# Altium schematic sheet schematic1.SchDoc (part 1 of 3) (continued)
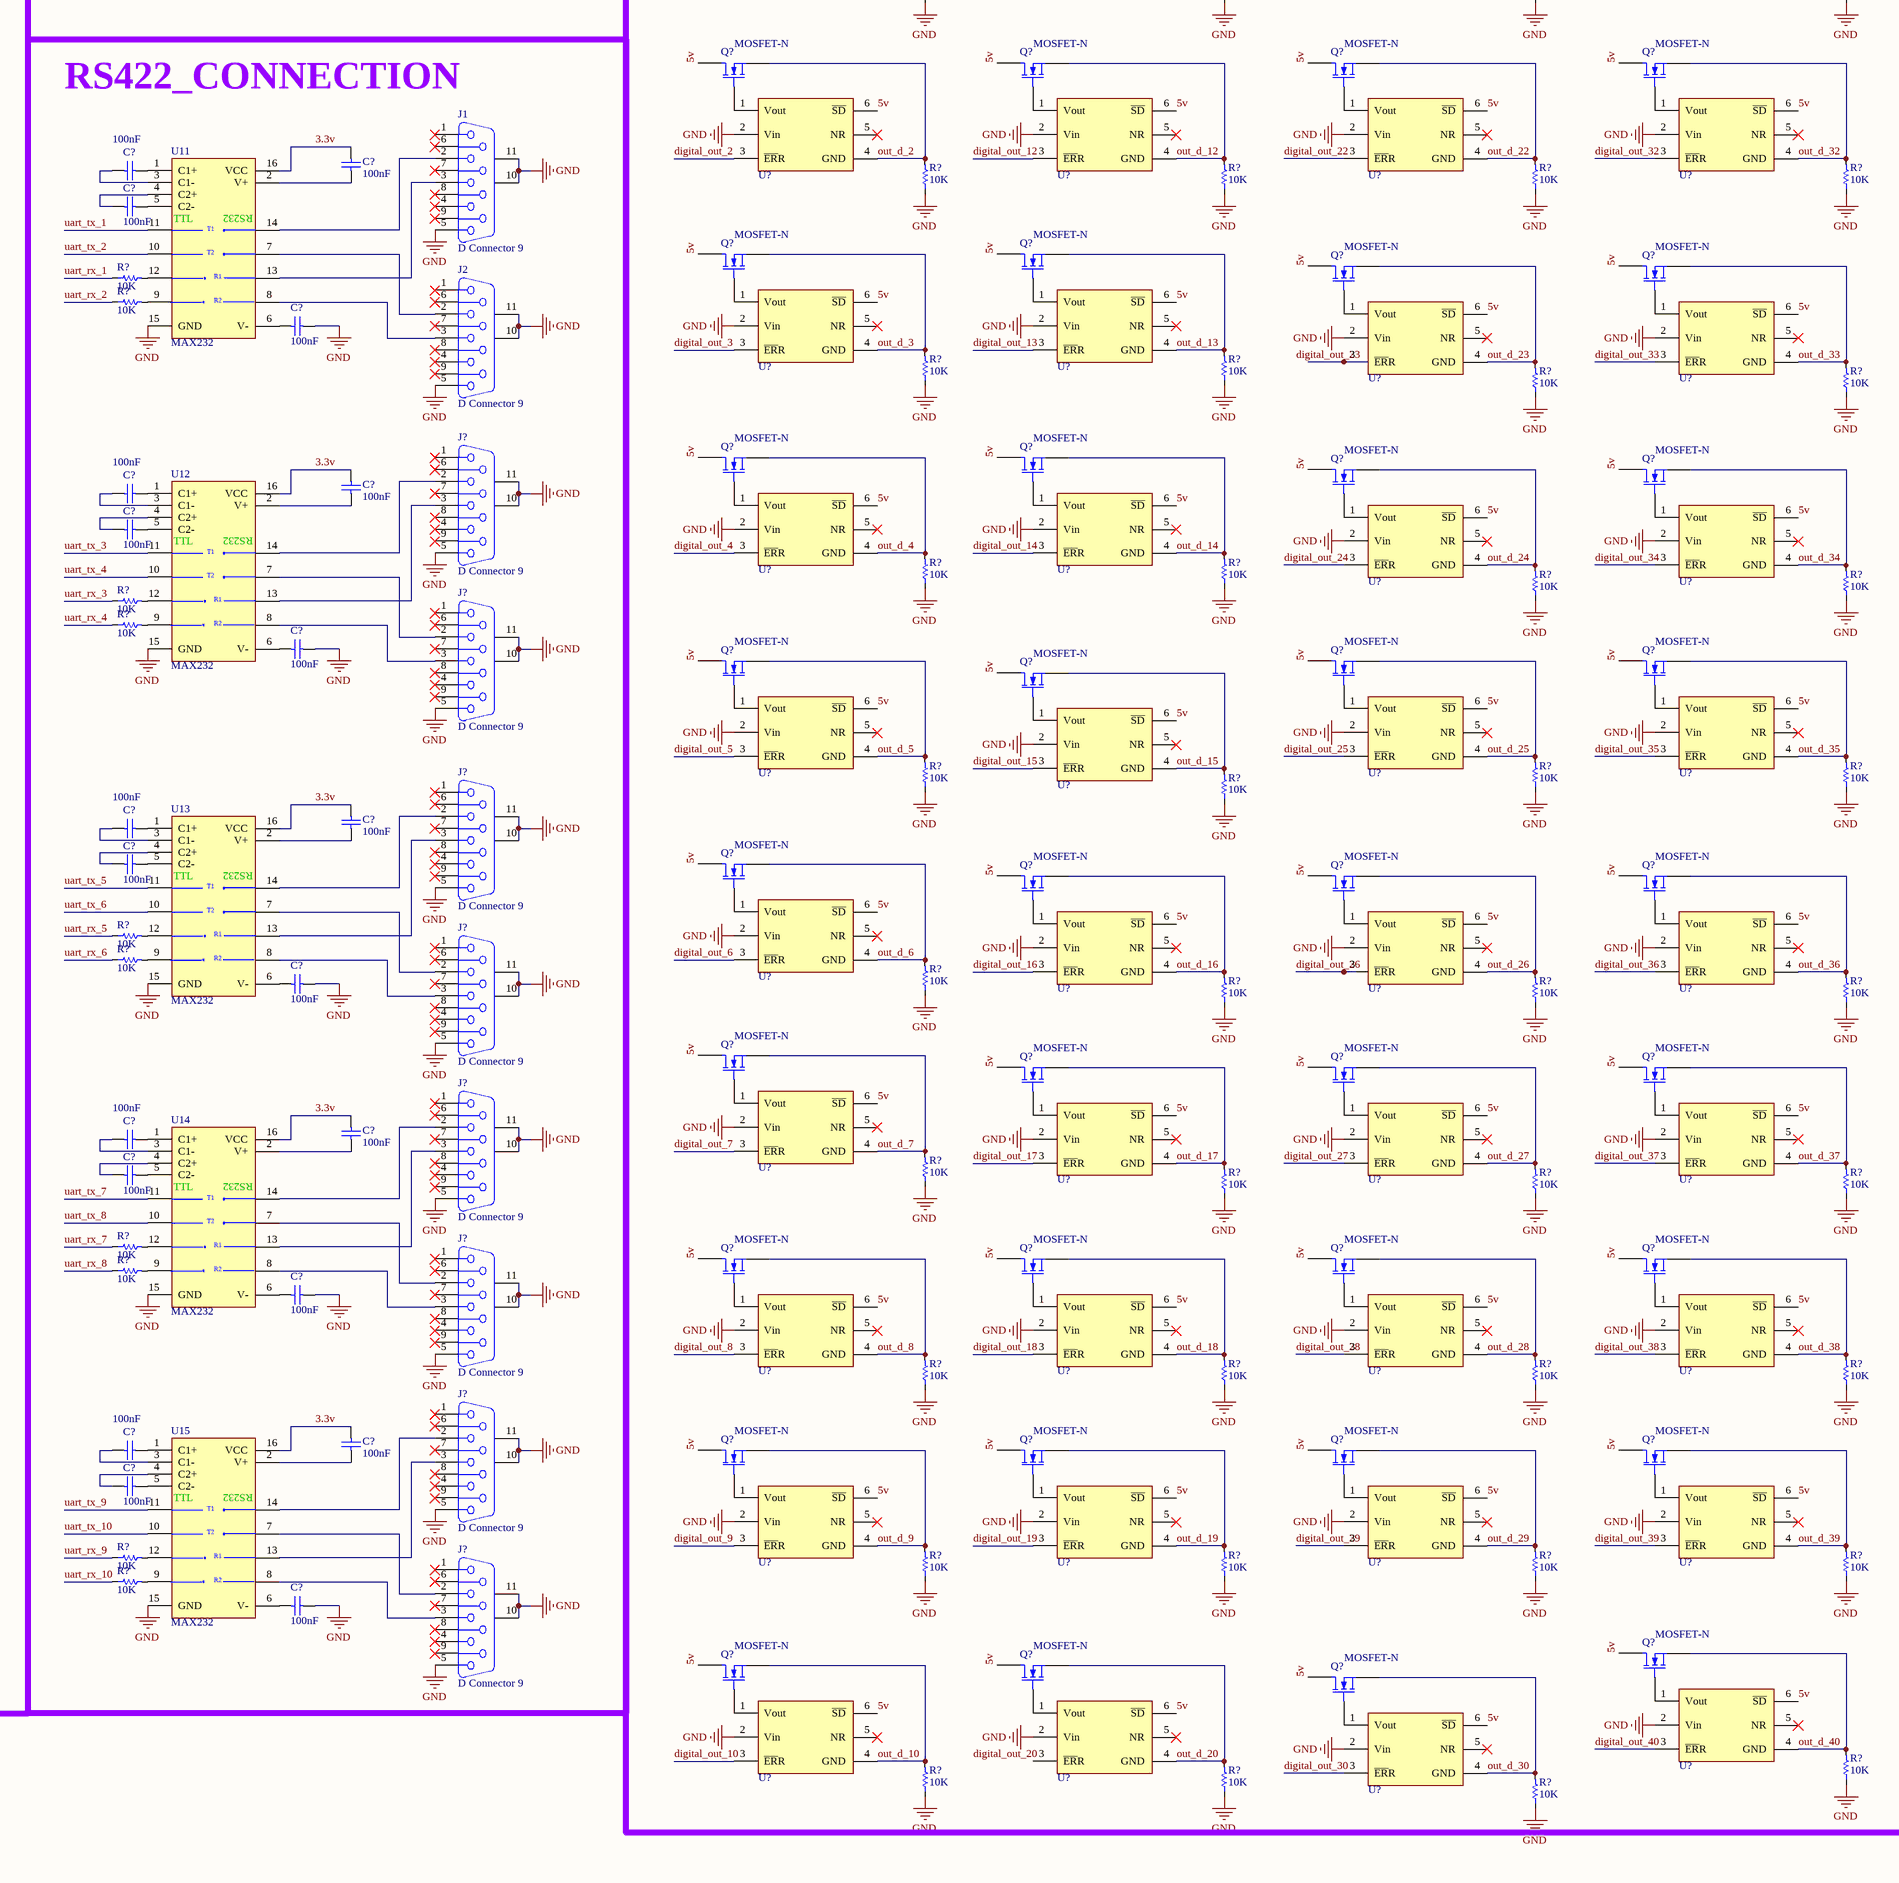
[diagram p6: schematic1.SchDoc, bottom column 3 of 4]
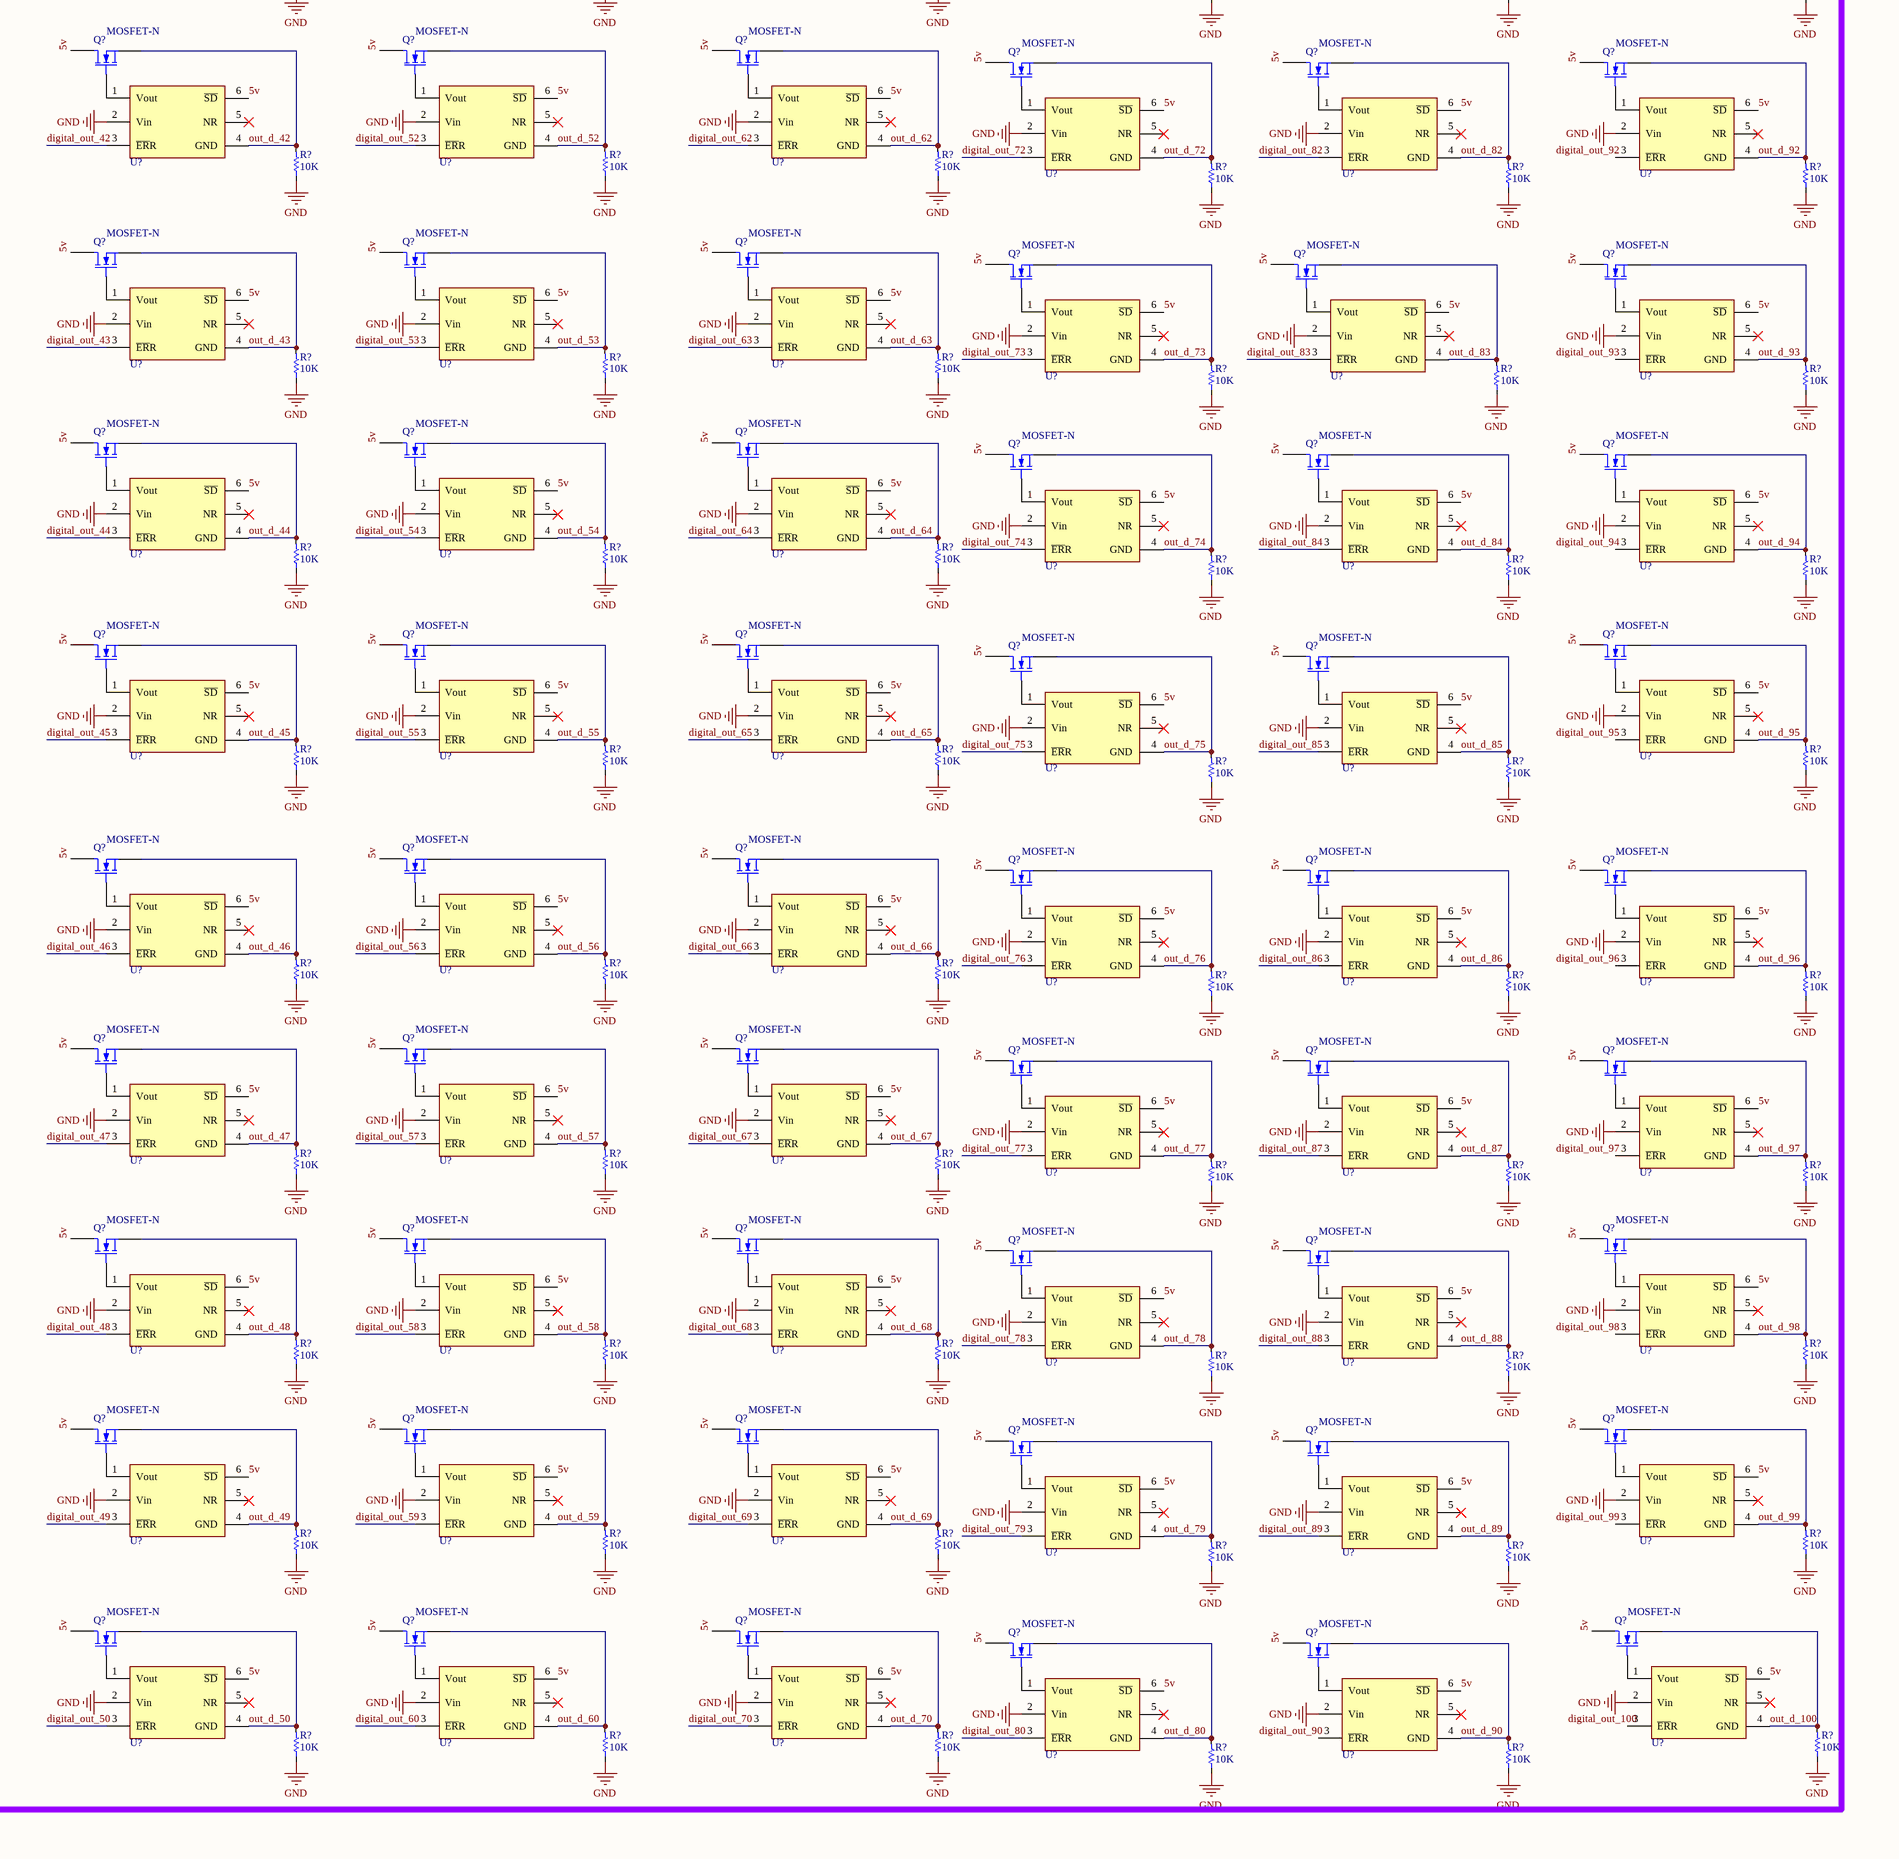
[diagram p7: schematic1.SchDoc, bottom column 4 of 4]

## Parts
(Parts that share a designator on the sheet are numbered #1, #2 ... from top to bottom, then left to right.)
bank33  XC7Z020-1CLG484I  [CLG484]  (part B of 10)
bank35  (no value)  [CLG484]  (part D of 10)
bank_13  XC7Z020-1CLG484I  [CLG484]  (part A of 10)
bank_34  XC7Z020-1CLG484I  [CLG484]  (part C of 10)
C1  100nF  [0603-Cap]
C2  100nF  [0603-Cap]
C?#1  100uf  [CAPC2012X94N]
C?#2  10nf  [CAPC2012X94N]
C?#3  10nf  [CAPC2012X94N]
C?#4  10nf  [CAPC2012X94N]
C?#5  47nf  [CAPC2012X94N]
C?#6  47nf  [CAPC2012X94N]
C?#7  47nf  [CAPC2012X94N]
C?#8  47nf  [CAPC2012X94N]
C?#9  47nf  [CAPC2012X94N]
C?#10  470nf  [CAPC2012X94N]
C?#11  4.7uf  [CAPC2012X94N]
C?#12  4.7uf  [CAPC2012X94N]
C?#13  4.7uf  [CAPC2012X94N]
C?#14  100uf  [CAPC2012X94N]
C?#15  100uf  [CAPC2012X94N]
C?#16  4.7uf  [CAPC2012X94N]
C?#17  4.7uf  [CAPC2012X94N]
C?#18  4.7uf  [CAPC2012X94N]
C?#19  470nf  [CAPC2012X94N]
C?#20  47nf  [CAPC2012X94N]
C?#21  47nf  [CAPC2012X94N]
C?#22  47nf  [CAPC2012X94N]
C?#23  47nf  [CAPC2012X94N]
C?#24  47nf  [CAPC2012X94N]
C?#25  10nf  [CAPC2012X94N]
C?#26  10nf  [CAPC2012X94N]
C?#27  10nf  [CAPC2012X94N]
C?#28  10nf  [CAPC2012X94N]
C?#29  10nf  [CAPC2012X94N]
C?#30  10nf  [CAPC2012X94N]
C?#31  47nf  [CAPC2012X94N]
C?#32  47nf  [CAPC2012X94N]
C?#33  47nf  [CAPC2012X94N]
C?#34  47nf  [CAPC2012X94N]
C?#35  47nf  [CAPC2012X94N]
C?#36  470nf  [CAPC2012X94N]
C?#37  4.7uf  [CAPC2012X94N]
C?#38  4.7uf  [CAPC2012X94N]
C?#39  4.7uf  [CAPC2012X94N]
C?#40  100uf  [CAPC2012X94N]
C?#41  100uf  [CAPC2012X94N]
C?#42  4.7uf  [CAPC2012X94N]
C?#43  4.7uf  [CAPC2012X94N]
C?#44  4.7uf  [CAPC2012X94N]
C?#45  470nf  [CAPC2012X94N]
C?#46  47nf  [CAPC2012X94N]
C?#47  47nf  [CAPC2012X94N]
C?#48  47nf  [CAPC2012X94N]
C?#49  47nf  [CAPC2012X94N]
C?#50  47nf  [CAPC2012X94N]
C?#51  10nf  [CAPC2012X94N]
C?#52  10nf  [CAPC2012X94N]
C?#53  10nf  [CAPC2012X94N]
C?#54  100nf  [CAPC2012X94N]
C?#55  100nf  [CAPC2012X94N]
C?#56  47nf  [CAPC2012X94N]
C?#57  47nf  [CAPC2012X94N]
C?#58  47nf  [CAPC2012X94N]
C?#59  47nf  [CAPC2012X94N]
C?#60  47nf  [CAPC2012X94N]
C?#61  47nf  [CAPC2012X94N]
C?#62  47nf  [CAPC2012X94N]
C?#63  10nf  [CAPC2012X94N]
C?#64  10nf  [CAPC2012X94N]
C?#65  10nf  [CAPC2012X94N]
C?#66  100nF  [0603-Cap]
C?#67  10nf  [CAPC2012X94N]
C?#68  100uf  [CAPC2012X94N]
C?#69  100uf  [CAPC2012X94N]
C?#70  100uf  [CAPC2012X94N]
C?#71  4.7uf  [CAPC2012X94N]
C?#72  4.7uf  [CAPC2012X94N]
C?#73  4.7uf  [CAPC2012X94N]
C?#74  4.7uf  [CAPC2012X94N]
C?#75  4.7uf  [CAPC2012X94N]
C?#76  470nf  [CAPC2012X94N]
C?#77  100nf  [CAPC2012X94N]
C?#78  100nf  [CAPC2012X94N]
C?#79  100nF  [0603-Cap]
C?#80  10nf  [CAPC2012X94N]
C?#81  10nf  [CAPC2012X94N]
C?#82  47nf  [CAPC2012X94N]
C?#83  47nf  [CAPC2012X94N]
C?#84  47nf  [CAPC2012X94N]
C?#85  470nf  [CAPC2012X94N]
C?#86  4.7uf  [CAPC2012X94N]
C?#87  4.7uf  [CAPC2012X94N]
C?#88  100uf  [CAPC2012X94N]
C?#89  47nf  [CAPC2012X94N]
C?#90  47nf  [CAPC2012X94N]
C?#91  47nf  [CAPC2012X94N]
C?#92  47nf  [CAPC2012X94N]
C?#93  47nf  [CAPC2012X94N]
C?#94  10nf  [CAPC2012X94N]
C?#95  10nf  [CAPC2012X94N]
C?#96  10nf  [CAPC2012X94N]
C?#97  10nf  [CAPC2012X94N]
C?#98  47nf  [CAPC2012X94N]
C?#99  47nf  [CAPC2012X94N]
C?#100  47nf  [CAPC2012X94N]
C?#101  470nf  [CAPC2012X94N]
C?#102  4.7uf  [CAPC2012X94N]
C?#103  4.7uf  [CAPC2012X94N]
C?#104  100uf  [CAPC2012X94N]
C?#105  100uf  [CAPC2012X94N]
C?#106  4.7uf  [CAPC2012X94N]
C?#107  4.7uf  [CAPC2012X94N]
C?#108  4.7uf  [CAPC2012X94N]
C?#109  470nf  [CAPC2012X94N]
C?#110  100nF  [CAPC2012X94N]
C?#111  10nf  [CAPC2012X94N]
C?#112  10nf  [CAPC2012X94N]
C?#113  10nf  [CAPC2012X94N]
C?#114  10nf  [CAPC2012X94N]
C?#115  47nf  [CAPC2012X94N]
C?#116  47nf  [CAPC2012X94N]
C?#117  47nf  [CAPC2012X94N]
C?#118  47nf  [CAPC2012X94N]
C?#119  47nf  [CAPC2012X94N]
C?#120  47nf  [CAPC2012X94N]
C?#121  47nf  [CAPC2012X94N]
C?#122  100nF  [CAPC2012X94N]
C?#123  100uf  [CAPC2012X94N]
C?#124  4.7uf  [CAPC2012X94N]
C?#125  470nf  [CAPC2012X94N]
C?#126  47nf  [CAPC2012X94N]
C?#127  47nf  [CAPC2012X94N]
C?#128  10nf  [CAPC2012X94N]
C?#129  470nf  [CAPC2012X94N]
C?#130  470nf  [CAPC2012X94N]
C?#131  4.7uf  [CAPC2012X94N]
C?#132  4.7uf  [CAPC2012X94N]
C?#133  4.7uf  [CAPC2012X94N]
C?#134  100uf  [CAPC2012X94N]
C?#135  100uf  [CAPC2012X94N]
C?#136  100uf  [CAPC2012X94N]
C?#137  4.7uf  [CAPC2012X94N]
C?#138  4.7uf  [CAPC2012X94N]
C?#139  470nf  [CAPC2012X94N]
C?#140  47nf  [CAPC2012X94N]
C?#141  47nf  [CAPC2012X94N]
C?#142  47nf  [CAPC2012X94N]
C?#143  10nf  [CAPC2012X94N]
C?#144  10nf  [CAPC2012X94N]
C?#145  10nf  [CAPC2012X94N]
C?#146  47nf  [CAPC2012X94N]
C?#147  47nf  [CAPC2012X94N]
C?#148  470nf  [CAPC2012X94N]
C?#149  4.7uf  [CAPC2012X94N]
C?#150  100uf  [CAPC2012X94N]
C?#151  10uf  [CAPC2012X94N]
C?#152  100nF  [0603-Cap]
C?#153  39pF  [CAPC0603X33N]
C?#154  39pF  [CAPC0603X33N]
C?#155  0.1uF  [CAPC1608X90N]
C?#156  0.1uF  [CAPC1608X90N]
C?#157  0.1uF  [CAPC1608X90N]
C?#158  0.1uF  [CAPC1608X90N]
C?#159  10nf  [CAPC2012X94N]
C?#160  100nF  [0603-Cap]
C?#161  10uF  [CAPC1005X65N]
C?#162  0.1uF  [CAPC1608X90N]
C?#163  0.1uF  [CAPC1608X90N]
C?#164  0.1uF  [CAPC1608X90N]
C?#165  100nF  [CAPC2012X94N]
C?#166  0.1uf  [CAPC1608X90N]
C?#167  10nf  [CAPC2012X94N]
C?#168  1 nf  [CAPC1608X90]
C?#169  0.1uF  [CAPC1608X90N]
C?#170  0.1uF  [CAPC1608X90N]
C?#171  0.1uF  [CAPC1608X90N]
C?#172  0.1uF  [CAPC1608X90N]
C?#173  0.1uF  [CAPC1608X90N]
C?#174  100nF  [CAPC2012X94N]
C?#175  100nF  [CAPC2012X94N]
C?#176  100nF  [CAPC2012X94N]
C?#177  100nF  [CAPC2012X94N]
C?#178  100nF  [CAPC2012X94N]
C?#179  100nF  [CAPC2012X94N]
C?#180  100nF  [CAPC2012X94N]
C?#181  100nF  [CAPC2012X94N]
C?#182  100nF  [CAPC2012X94N]
C?#183  100nF  [CAPC2012X94N]
C?#184  100nF  [CAPC2012X94N]
C?#185  100nF  [CAPC2012X94N]
C?#186  100nF  [CAPC2012X94N]
C?#187  100nF  [CAPC2012X94N]
C?#188  100nF  [CAPC2012X94N]
C?#189  100nF  [CAPC2012X94N]
C?#190  100nF  [CAPC2012X94N]
C?#191  100nF  [CAPC2012X94N]
C?#192  100nF  [CAPC2012X94N]
C?#193  100nF  [CAPC2012X94N]
C?#194  100nF  [CAPC2012X94N]
C?#195  100nF  [CAPC2012X94N]
C?#196  100nF  [CAPC2012X94N]
C?#197  100nF  [CAPC2012X94N]
C?#198  100nF  [CAPC2012X94N]
C?#199  100nF  [CAPC2012X94N]
C?#200  100nF  [CAPC2012X94N]
C?#201  100nF  [CAPC2012X94N]
C?#202  100nF  [CAPC2012X94N]
C?#203  100nF  [CAPC2012X94N]
C?#204  100nF  [CAPC2012X94N]
C?#205  100nF  [CAPC2012X94N]
C?#206  100nF  [CAPC2012X94N]
C?#207  100nF  [CAPC2012X94N]
C?#208  100nF  [CAPC2012X94N]
C?#209  100nF  [CAPC2012X94N]
C?#210  100nF  [CAPC2012X94N]
C?#211  100nF  [CAPC2012X94N]
C?#212  100nF  [CAPC2012X94N]
C?#213  100nF  [CAPC2012X94N]
C?#214  100nF  [CAPC2012X94N]
C?#215  100nF  [CAPC2012X94N]
C?#216  100nF  [CAPC2012X94N]
C?#217  100nF  [CAPC2012X94N]
C?#218  100nF  [CAPC2012X94N]
C?#219  100nF  [CAPC2012X94N]
C?#220  100nF  [CAPC2012X94N]
C?#221  100nF  [CAPC2012X94N]
C?#222  100nF  [CAPC2012X94N]
C?#223  100nF  [CAPC2012X94N]
C?#224  100nF  [CAPC2012X94N]
C?#225  100nF  [CAPC2012X94N]
C?#226  100nF  [CAPC2012X94N]
C?#227  100nF  [CAPC2012X94N]
C?#228  100nF  [CAPC2012X94N]
C?#229  100nF  [CAPC2012X94N]
C?#230  100nF  [CAPC2012X94N]
C?#231  100nF  [CAPC2012X94N]
C?#232  100nF  [CAPC2012X94N]
C?#233  100nF  [CAPC2012X94N]
C?#234  100nF  [CAPC2012X94N]
C?#235  100nF  [CAPC2012X94N]
D?#1  D20  [DIOM4325X250N]
D?#2  D20  [DIOM4325X250N]
D?#3  D20  [DIOM4325X250N]
D?#4  D20  [DIOM4325X250N]
D?#5  BLUE  [LEDC2012X70N]
D?#6  (no value)  [SOD-323]
FL?#1  600  [FIL_NFZ32BW3R6HZ10L]
FL?#2  220  [FIL_NFZ32BW3R6HZ10L]
FL?#3  220  [FIL_NFZ32BW3R6HZ10L]
J1  D Connector 9  [DSUB1.385-2H9]
J2  D Connector 9  [DSUB1.385-2H9]
J?#1  1840772-8  [BEL_1840772-8]
J?#2  640445-3  [TE_640445-3]
J?#3  640445-3  [TE_640445-3]
J?#4  640445-3  [TE_640445-3]
J?#5  640445-3  [TE_640445-3]
J?#6  TSM-107-01-F-DV-A  [SAMTEC_TSM-107-01-F-DV-A]
J?#7  640445-3  [TE_640445-3]
J?#8  TSM-110-01-L-DV-TR  [SAMTEC_TSM-110-01-L-DV-TR]
J?#9  D Connector 9  [DSUB1.385-2H9]